# EasyEDA Pro project Designs.eprj, board PCB46
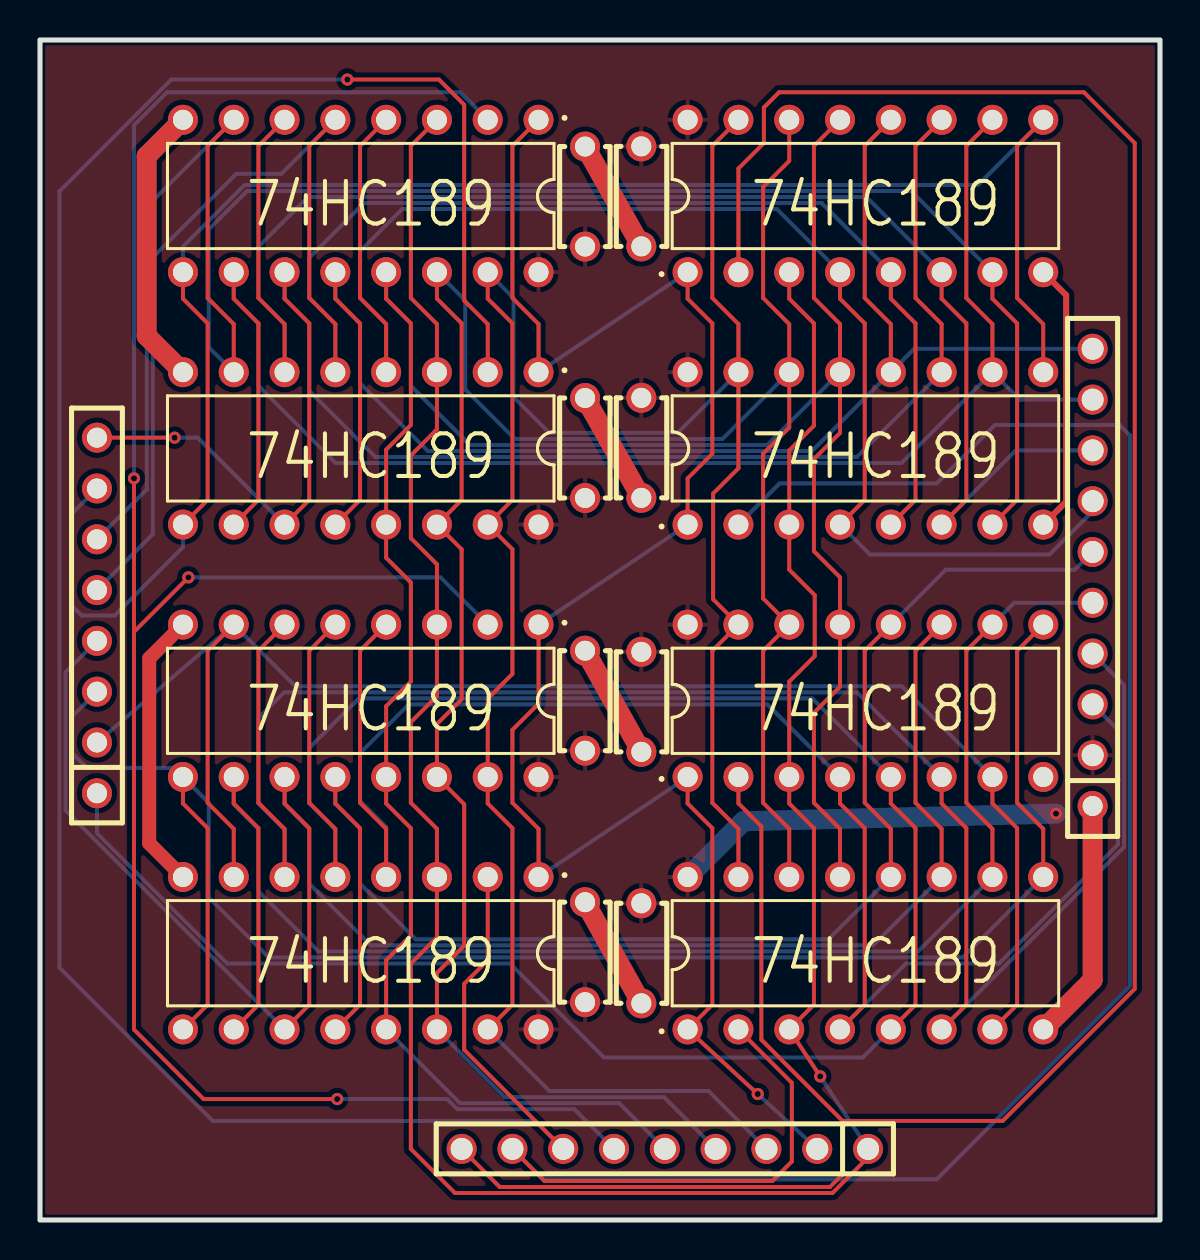
[diagram p9: board, top side]
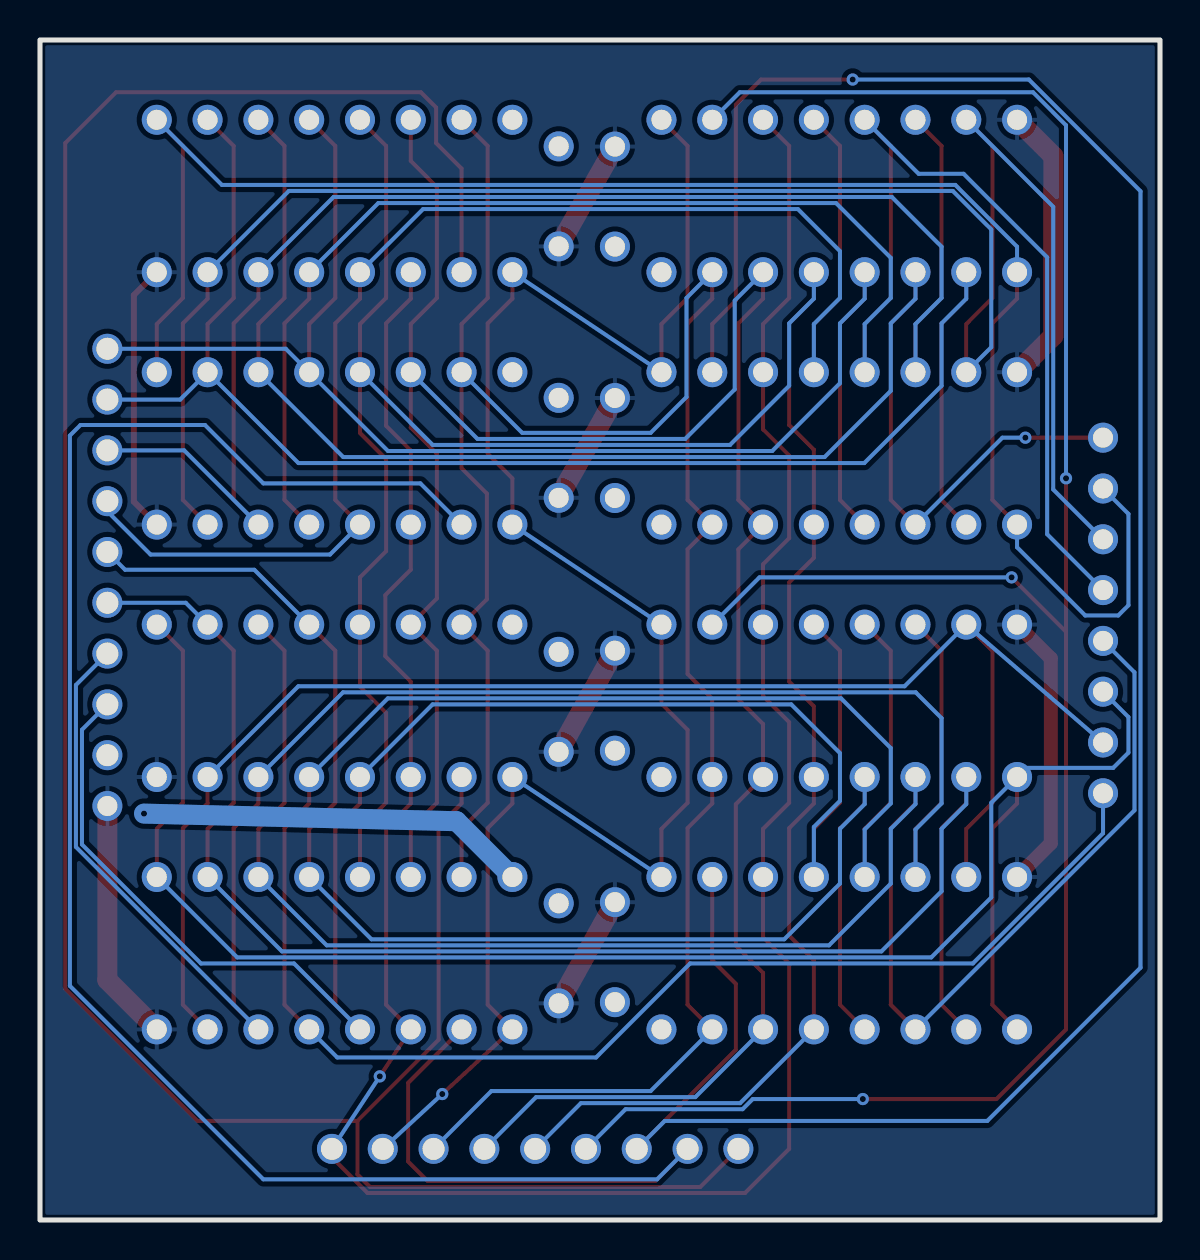
[diagram p10: board, bottom side, seen from below]

Outline 56 x 59 mm; copper layers: Top Layer, Bottom Layer. Coordinates in mm from the lower left corner of the outline.
Outline path: rectangle 0,59 56,0
Stack: Top Layer 0.035mm / Dielectric1 1.51mm FR4 er 4.5 / Bottom Layer 0.035mm

## Design rules (mm)
template: Custom Config
spacing copperThickness1oz (default): track to track 0.102, other pairs 0.152 to 0.3
spacing copperThickness2oz: track to track 0.203, other pairs 0.152 to 0.3
track width copperThickness1oz (default): min 0.127, default 0.2, max 2.54
track width copperThickness2oz: min 0.203, default 0.254, max 2.54
differential pair differentialPair (default): width min 0.127, default 0.254, max 2.54; gap min 0.152, default 0.152
via viaSize (default): diameter min 0.5, default 0.61, max 10; hole min 0.3, default 0.305, max 6.3

## Placement (name value [footprint] x y rotation side)
C61  100nF  [CAP-TH_L5.0-W2.5-P5.00-D1.0]  30.07 38.61 90 top
C62  100nF  [CAP-TH_L5.0-W2.5-P5.00-D1.0]  30.07 51.18 90 top
C63  100nF  [CAP-TH_L5.0-W2.5-P5.00-D1.0]  30.07 25.91 90 top
C64  100nF  [CAP-TH_L5.0-W2.5-P5.00-D1.0]  30.07 13.33 90 top
C66  100nF  [CAP-TH_L5.0-W2.5-P5.00-D1.0]  27.25 25.97 270 top
C67  100nF  [CAP-TH_L5.0-W2.5-P5.00-D1.0]  27.25 13.39 270 top
C68  100nF  [CAP-TH_L5.0-W2.5-P5.00-D1.0]  27.25 51.17 270 top
C69  100nF  [CAP-TH_L5.0-W2.5-P5.00-D1.0]  27.25 38.6 270 top
U356  TH2.54_8P_0.6  [HDR-TH_8P-P2.54-V-M-3]  2.85 30.23 90 top
U370  CD74HC173E  [PDIP-16_L19.2-W6.6-P2.54-LS7.6-BL]  16.04 25.96 180 top
U377  HDR2.54-LI-9P  [HDR-TH_9P-P2.54-V-M]  31.24 3.56 180 top
U378  CD74HC173E  [PDIP-16_L19.2-W6.6-P2.54-LS7.6-BL]  16.04 51.2 180 top
U379  CD74HC173E  [PDIP-16_L19.2-W6.6-P2.54-LS7.6-BL]  16.04 13.34 180 top
U380  CD74HC173E  [PDIP-16_L19.2-W6.6-P2.54-LS7.6-BL]  16.04 38.58 180 top
U381  CD74HC173E  [PDIP-16_L19.2-W6.6-P2.54-LS7.6-BL]  41.27 13.34 0 top
U382  CD74HC173E  [PDIP-16_L19.2-W6.6-P2.54-LS7.6-BL]  41.27 38.58 0 top
U383  CD74HC173E  [PDIP-16_L19.2-W6.6-P2.54-LS7.6-BL]  41.27 25.96 0 top
U384  CD74HC173E  [PDIP-16_L19.2-W6.6-P2.54-LS7.6-BL]  41.27 51.2 0 top
U385  cn10_2r54_10x1  [HDR-TH_10P-P2.54-V-F]  52.63 32.13 90 top

## Footprints (pads in the part's own frame, mm; a bottom-side part is the same pattern mirrored in y, then rotated)
CAP-TH_L5.0-W2.5-P5.00-D1.0
  round 1.5 hole 1: 1(-2.5,0) 2(2.5,0)
HDR-TH_8P-P2.54-V-M-3
  round 1.5 hole 1: 1(-8.89,0) 2(-6.35,0) 3(-3.81,0) 4(-1.27,0) 5(1.27,0) 6(3.81,0) 7(6.35,0) 8(8.89,0)
HDR-TH_9P-P2.54-V-M
  round 1.5 hole 1.1x1: 1(-10.16,0) 2(-7.62,0) 3(-5.08,0) 4(-2.54,0) 5(0,0) 6(2.54,0) 7(5.08,0) 8(7.62,0) 9(10.16,0)
HDR-TH_10P-P2.54-V-F
  round 1.5 hole 1x1.1: 1(-11.43,0)
  round 1.5 hole 1.1x1: 2(-8.89,0) 3(-6.35,0) 4(-3.81,0) 5(-1.27,0) 6(1.27,0) 7(3.81,0) 8(6.35,0) 9(8.89,0) 10(11.43,0)
PDIP-16_L19.2-W6.6-P2.54-LS7.6-BL
  round 1.5 hole 1: 1(-8.89,-3.81) 2(-6.35,-3.81) 3(-3.81,-3.81) 4(-1.27,-3.81) 5(1.27,-3.81) 6(3.81,-3.81) 7(6.35,-3.81) 8(8.89,-3.81) 9(8.89,3.81) 10(6.35,3.81) 11(3.81,3.81) 12(1.27,3.81) 13(-1.27,3.81) 14(-3.81,3.81) 15(-6.35,3.81) 16(-8.89,3.81)

## Nets
As in the schematic.

## Via types
v1: diameter 0.61, hole 0.305, Top Layer to Bottom Layer, 8 vias

## Routing (per net, layer and track width the routed paths; a pad name or vN(x,y) marks a point on that pad's centre or on a via; arc(x,y) is an arc through that point)
GND: length 76.9
  Top Layer w0.3: U384.8 51.31,46.24 51.31,35.92 U382.8
  Top Layer w0.7: U379.8 5.46,18.84 5.46,28.08 U370.8
  Top Layer w1: U380.8 5.33,44.2 5.33,53.2 U378.8 ; C61.1 C69.1 ; C63.1 C66.1 ; U385.1 52.63,12 U381.8 ; C64.1 C67.1 ; C62.1 C68.1
VCC: length 19.6
  Bottom Layer w1: v1(50.8,20.32) 35.17,19.94 U381.16
A0: length 90.4
  Top Layer w0.2: U382.1 32.38,37.08 33.62,38.31 33.62,44.83 32.38,46.07 U384.1 ; U383.1 32.38,20.83 33.62,19.59 33.62,10.77 U381.1 v1(35.89,6.3) ; U380.1 24.93,44.8 23.62,46.1 23.62,53.7 U378.1 ; U370.1 24.93,25.82 23.62,24.51 23.62,20.86 24.93,19.56 U379.1
  Bottom Layer w0.2: v1(35.89,6.3) U377.2 ; U384.1 U380.1 ; U383.1 U379.1 ; U382.1 U370.1
A1: length 118.4
  Top Layer w0.2: U378.15 22.39,46.07 23.62,44.83 23.62,36 U380.15 23.62,33.53 23.62,27.31 22.39,26.07 U370.15 22.39,20.83 23.62,19.59 23.62,10.77 U379.15 ; U381.15 34.92,19.56 33.62,20.86 33.62,28.47 U383.15 33.66,31.04 33.66,36.32 34.92,37.59 U382.15 34.92,44.8 33.62,46.1 33.62,53.7 U384.15
  Bottom Layer w0.2: U377.3 33.43,6.45 25.47,6.45 U379.15 ; U382.15 31.89,39.36 25.47,39.36 23.68,41.15 23.68,46.1 U378.15
A2: length 123.6
  Top Layer w0.2: U381.14 37.46,19.56 36.16,20.86 36.16,28.47 U383.14 36.16,31.08 36.16,38.31 37.46,39.62 U382.14 37.46,44.8 36.16,46.1 36.16,51.65 37.46,52.95 U384.14 ; U378.14 19.85,46.07 21.08,44.83 21.08,36 U380.14 21.08,33.53 21.08,26.03 19.85,24.8 U370.14 21.21,20.79 21.21,13.72 19.85,12.35 U379.14
  Bottom Layer w0.2: U379.14 23.23,6.14 31.19,6.14 U377.4 ; U382.14 34.12,39.05 23.74,39.05 21.26,41.53 21.26,45.97 U378.14
A3: length 128.8
  Top Layer w0.2: U381.13 40,19.56 38.7,20.86 38.7,25.36 40,26.67 U383.13 40,32.14 38.7,33.44 38.7,38.05 40,39.35 U382.13 40,44.8 38.7,46.1 38.7,53.7 U384.13 ; U379.13 17.31,12.99 18.54,14.22 18.54,19.59 17.31,20.83 U370.13 17.31,25.69 18.54,26.92 18.54,31.88 17.31,33.11 U380.13 17.31,38.52 18.54,39.75 18.54,44.83 17.31,46.07 U378.13
  Bottom Layer w0.2: U378.13 17.31,46.07 18.54,44.83 18.54,41.71 21.5,38.75 36.36,38.75 U382.13 ; U379.13 21,5.84 28.96,5.84 U377.5
DATA0: length 85.9
  Top Layer w0.2: U381.4 41.24,10.77 41.24,19.59 40,20.83 U383.4 ; U379.4 17.31,19.56 16,20.86 16,28.47 U370.4
  Bottom Layer w0.2: U381.4 43.3,12.83 47.95,12.83 53.9,18.78 53.9,24.51 U385.3 ; U383.4 36.37,25.78 18.44,25.78 16,23.34 16,20.95 17.31,19.65 U379.4
DATA1: length 95.5
  Top Layer w0.2: U379.6 12.23,19.56 10.92,20.86 10.92,28.47 U370.6 ; U381.6 46.32,10.77 46.32,19.59 45.08,20.83 U383.6
  Bottom Layer w0.2: U385.4 54.2,26.75 54.2,18.65 U381.6 ; U379.6 12.23,19.52 10.92,20.83 10.92,25.09 12.22,26.39 40.85,26.39 U383.6
DATA2: length 78.5
  Top Layer w0.2: U379.10 10.92,10.77 10.92,19.59 9.69,20.83 U370.10 ; U381.10 47.62,19.56 46.32,20.86 46.32,28.47 U383.10
  Bottom Layer w0.2: U385.5 48.71,30.86 U383.10 ; U381.10 43.9,13.43 13.93,13.43 10.92,16.44 10.92,19.56 9.69,20.79 U370.10
DATA3: length 73.8
  Top Layer w0.2: U379.12 16,10.77 16,19.59 14.77,20.83 U370.12 ; U381.12 42.54,19.56 41.24,20.86 41.24,28.47 U383.12
  Bottom Layer w0.2: U385.6 51.74,32.51 45.28,32.51 U383.12 ; U370.12 14.77,20.79 16,19.56 16,16.82 18.78,14.03 39.43,14.03 U381.12
DATA4: length 74.8
  Top Layer w0.2: U378.4 16,53.7 16,46.1 17.31,44.8 U380.4 ; U382.4 41.24,36 41.24,44.83 40,46.07 U384.4
  Bottom Layer w0.2: U380.4 17.31,44.8 16,46.1 16,48.44 18.1,50.55 36.84,50.55 U384.4 ; U385.7 52.63,35.43 50.47,33.27 41.5,33.27 U382.4
DATA5: length 80
  Top Layer w0.2: U378.6 10.92,53.7 10.92,46.1 12.23,44.8 U380.6 ; U382.6 46.32,36 46.32,44.83 45.08,46.07 U384.6
  Bottom Layer w0.2: U384.6 41.32,51.15 13.41,51.15 10.92,48.67 10.92,46.1 12.23,44.8 U380.6 ; U382.6 48.79,38.48 U385.8
DATA6: length 79.3
  Top Layer w0.2: U384.10 46.32,53.7 46.32,46.1 47.62,44.8 U382.10 ; U378.10 9.69,46.07 10.92,44.83 10.92,36 U380.10
  Bottom Layer w0.2: U378.10 9.69,46.07 10.92,44.83 10.92,41.71 14.79,37.85 43.08,37.85 U382.10 48.99,41.02 U385.9
DATA7: length 73.6
  Top Layer w0.2: U380.12 16,36 16,44.83 14.77,46.07 U378.12 ; U382.12 42.54,44.8 41.24,46.1 41.24,53.7 U384.12
  Bottom Layer w0.2: U385.10 43.71,43.56 U382.12 38.6,38.45 19.39,38.45 16,41.84 16,44.83 14.77,46.07 U378.12
OUT0: length 113
  Top Layer w0.2: U381.5 43.78,10.77 43.78,19.59 42.54,20.83 U383.5 ; U379.5 14.77,19.56 13.46,20.86 13.46,28.47 U370.5
  Bottom Layer w0.2: U381.5 41.14,8.13 28.19,8.13 23.5,12.83 9.36,12.83 2.85,19.34 U356.1 ; U383.5 38.61,26.08 15.95,26.08 13.46,23.6 13.46,20.83 14.77,19.52 U379.5
OUT1: length 77.5
  Top Layer w0.2: U370.7 8.38,28.47 8.38,20.86 9.69,19.56 U379.7 ; U383.7 47.62,20.83 48.86,19.59 48.86,10.77 U381.7
  Bottom Layer w0.2: U383.7 43.08,26.69 12.77,26.69 U370.7 U356.2
OUT2: length 88.2
  Top Layer w0.2: U383.9 48.86,28.47 48.86,20.86 50.16,19.56 U381.9 ; U370.9 7.15,20.83 8.38,19.59 8.38,10.77 U379.9
  Bottom Layer w0.2: U381.9 46.14,13.13 11.44,13.13 8.44,16.13 8.44,20.86 U370.9 6.69,22.61 2.34,22.61 1.58,23.37 1.58,25.15 U356.3
OUT3: length 92.1
  Top Layer w0.2: U370.11 12.23,20.83 13.46,19.59 13.46,10.77 U379.11 ; U381.11 45.08,19.56 43.78,20.86 43.78,28.47 U383.11
  Bottom Layer w0.2: U379.11 1.28,20.48 1.28,27.38 U356.4 ; U370.11 12.23,20.79 13.46,19.56 13.46,16.82 16.55,13.73 41.66,13.73 U381.11
OUT4: length 95
  Top Layer w0.2: U380.5 14.77,44.8 13.46,46.1 13.46,53.7 U378.5 ; U382.5 43.78,36 43.78,44.83 42.54,46.07 U384.5
  Bottom Layer w0.2: U380.5 14.77,44.8 13.46,46.1 13.46,48.11 16.2,50.85 39.08,50.85 U384.5 ; U378.5 12.07,52.31 9.82,52.31 5.64,48.13 5.64,34.29 U356.5
OUT5: length 100.5
  Top Layer w0.2: U380.7 9.69,44.8 8.38,46.1 8.38,53.7 U378.7 ; U382.7 48.86,36 48.86,44.83 47.62,46.07 U384.7
  Bottom Layer w0.2: U380.7 8.44,43.64 8.44,49.53 10.36,51.45 43.56,51.45 U384.7 ; U378.7 5.34,50.66 5.34,36.53 U356.6
OUT6: length 89
  Top Layer w0.2: U384.9 48.86,53.7 48.86,46.1 50.16,44.8 U382.9 ; U380.9 8.38,36 8.38,44.83 7.15,46.07 U378.9
  Bottom Layer w0.2: U384.9 46.91,51.75 10.23,51.75 7.15,48.67 U378.9 ; U380.9 7.15,33.64 3.74,30.23 2.09,30.23 1.58,30.73 1.58,35.31 U356.7
OUT7: length 79.7
  Top Layer w0.2: U382.11 45.08,44.8 43.78,46.1 43.78,53.7 U384.11 ; U378.11 12.23,46.07 13.46,44.83 13.46,36 U380.11 ; U356.8 v1(6.73,39.12)
  Bottom Layer w0.2: U382.11 40.84,38.15 16.77,38.15 13.46,41.46 13.46,44.83 12.23,46.07 U378.11 ; v1(6.73,39.12) 7.88,39.12 U380.11
S0: length 110.4
  Top Layer w0.2: 4.7,29.41 4.7,9.53 8.18,6.05 v1(14.86,6.05) ; 4.7,29.41 v1(4.7,37.08) ; 4.7,29.41 v1(7.42,32.13)
  Bottom Layer w0.2: v1(4.7,37.08) 4.7,54.74 6.35,56.39 21.01,56.39 U378.2 ; U377.6 26.72,5.54 20.87,5.54 20.36,6.05 v1(14.86,6.05) ; v1(7.42,32.13) 20.03,32.13 U370.2
S1: length 120.8
  Top Layer w0.2: U380.2 22.39,44.8 21.21,45.97 21.21,55.76 19.95,57.02 v1(15.37,57.02) ; U379.2 22.39,12.99 21.21,11.81 21.21,8.51 U377.7
  Bottom Layer w0.2: U377.7 24.76,4.95 8.64,4.95 0.97,12.61 0.97,51.44 6.56,57.02 v1(15.37,57.02)
S2: length 107.7
  Top Layer w0.2: U377.8 25.22,1.95 36.62,1.95 37.59,2.93 37.59,6.86 U381.2
  Bottom Layer w0.2: U382.2 36.98,36.83 44.83,36.83 47.75,39.75 53.97,39.75 54.51,39.22 54.51,11.71 44.83,2.03 25.15,2.03 U377.8
S3: length 130.4
  Top Layer w0.2: U377.9 22.99,1.65 39.5,1.65 40.13,2.29 40.13,4.95 ; U383.2 34.92,20.83 36.07,19.69 36.07,9.02 40.13,4.95 ; 40.13,4.95 48.13,4.95 54.74,11.56 54.74,53.85 52.2,56.39 36.96,56.39 36.19,55.63 36.19,53.85 34.92,52.57 U384.2
WRITE: length 128.3
  Top Layer w0.2: U384.3 37.46,46.07 38.7,44.83 38.7,39.71 37.46,38.48 U382.3 37.46,32.52 38.74,31.24 38.74,28.19 37.46,26.92 U383.3 37.46,20.83 38.7,19.59 38.7,10.77 U381.3 v1(39.01,7.18) ; U378.3 18.54,53.7 18.54,46.1 19.85,44.8 U380.3 19.85,39.53 18.54,38.23 18.54,34.09 19.85,32.78 U370.3 19.85,26.2 18.54,24.89 18.54,20.86 19.85,19.56 U379.3 19.85,14.13 18.54,12.83 18.54,3.56 20.75,1.35 39.62,1.35 41.4,3.13 U377.1
  Bottom Layer w0.2: U377.1 v1(39.01,7.18)

## Copper pours and planes (outline as drawn; the poured copper is in the pictures)
GND on Bottom Layer: 0,59 56,59 56,0 0,0
VCC on Top Layer: 0,59 56,59 56,0 0,0

## Text on the board
Top Silkscreen Layer: 74HC189
